# EasyEDA Pro project C108_STM32.eprj, schematic Schematic1
Board Name: Board1; Create Date: 2024-11-23; Page Name: P1; Project Name: C108_STM32; Schematic Name: Schematic1; Update Date: 2024-11-24; Company: 嘉立创EDA; Page Size: A4; Version: V1.0
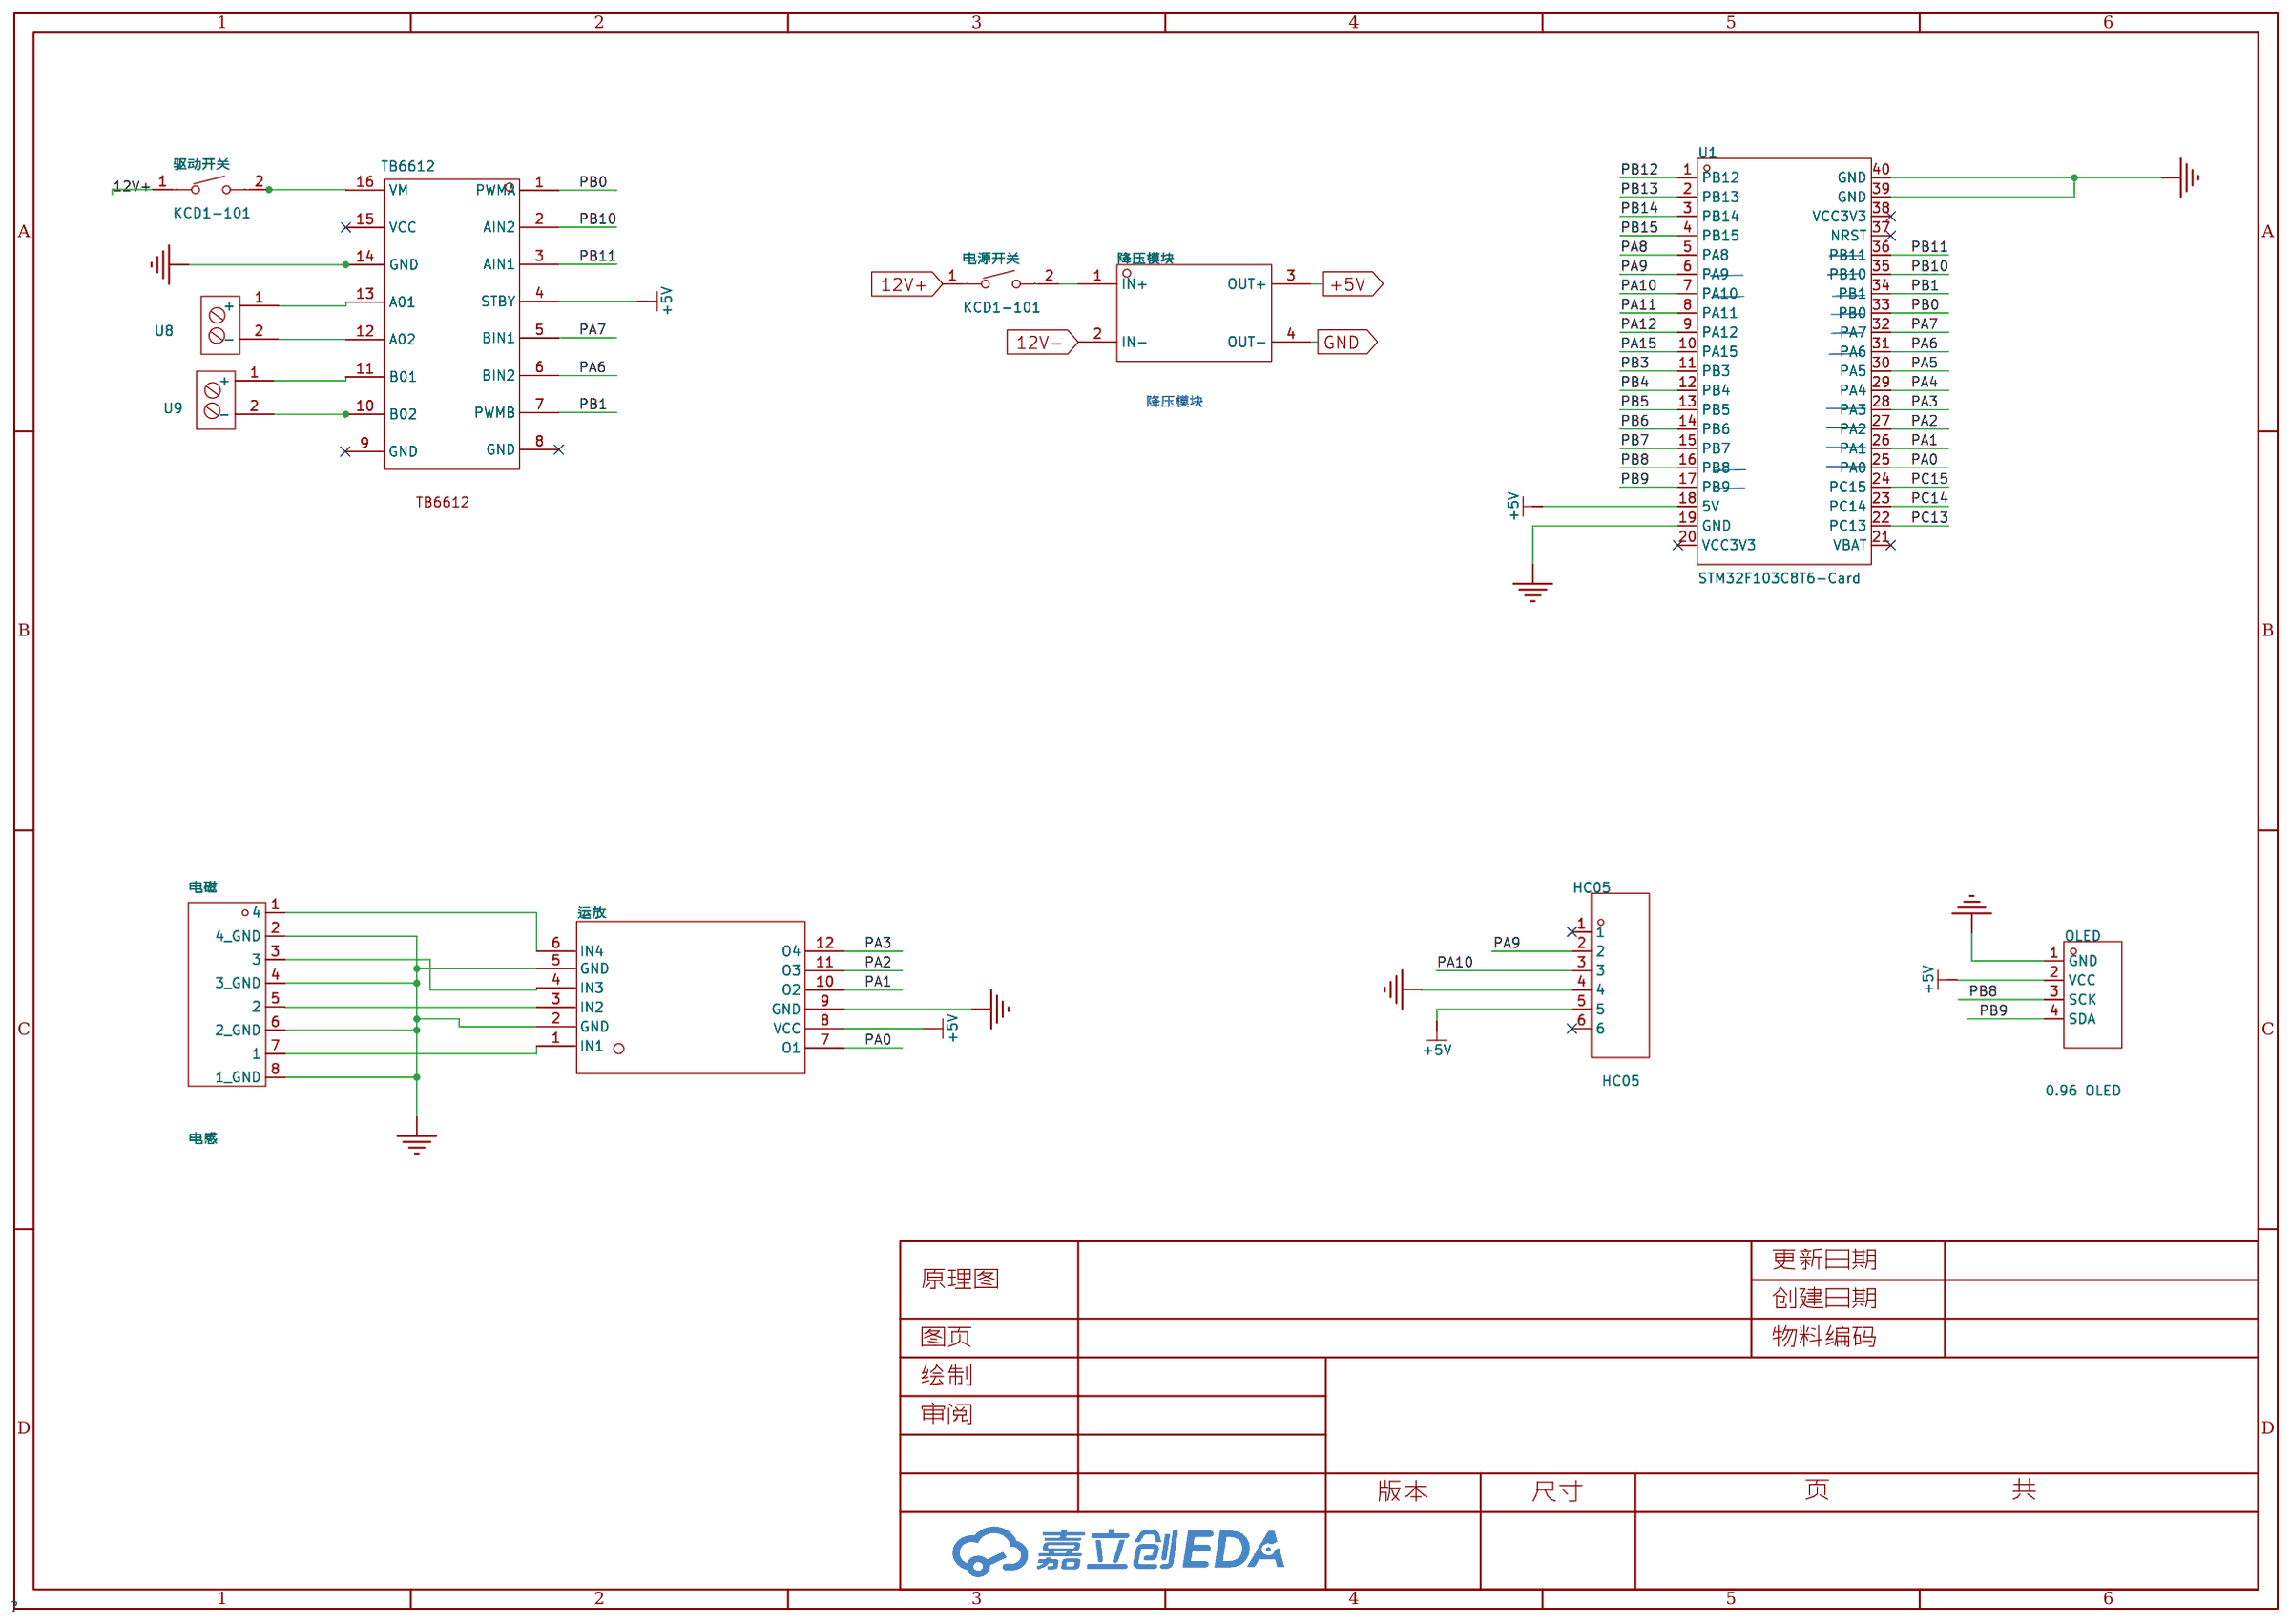
[diagram p0: schematic sheet]

## Parts
HC05  HC05  [HDR-TH_6P-P2.54-V-M]
OLED  0.96 OLED  [HDR-TH_4P-P2.54-V-M-1]
TB6612  -  [TB6612_Board]
U1  STM32F103C8T6-Card  [CONN-TH_L53.3-W22.9_STM32F103C8T6-CARD]
U8  -  [端子]
U9  -  [端子]
电源开关  KCD1-101  [SW-TH_KCD1-101]
电磁  电感  [HDR-TH_8P-P2.54-V-M]
运放  -  [逐飞运放]
降压模块  -  [稳压模块]
驱动开关  KCD1-101  [SW-TH_KCD1-101]

## Library data of the parts
HC05 = 单排2.54*6: Supplier Part: C9900016160; Supplier Footprint: 2.54x2x6; JLCPCB Part Class: 扩展库; Supplier: LCSC
OLED = 2.54*4单排: Supplier Part: C9900016163; Supplier Footprint: 2.54x4; JLCPCB Part Class: 扩展库; Supplier: LCSC
TB6612 = TB6612_Board
U1 = STM32F103C8T6-Card: Supplier Part: C9900077949; Supplier Footprint: 插件; Supplier: LCSC
U8 U9 = 端子
电源开关 驱动开关 = KCD1-101: Supplier Part: C9900022451; Supplier Footprint: Throughhole; JLCPCB Part Class: 扩展库; Supplier: LCSC
电磁 = 2.54*8单排: Supplier Part: C9900016164; Supplier Footprint: 2.54x8; JLCPCB Part Class: 扩展库; Supplier: LCSC
运放 = 逐飞运放
降压模块 = 降压模块

## Nets
12V+: 电源开关.1
12V-: 降压模块.2(IN-)
+5V: HC05.5 OLED.2(VCC) TB6612.4(STBY) U1.18(5V) 运放.8(VCC) 降压模块.3(OUT+)
GND: HC05.4 OLED.1(GND) TB6612.14(GND) U1.19(GND) U1.39(GND) U1.40(GND) 电磁.2(4_GND) 电磁.4(3_GND) 电磁.6(2_GND) 电磁.8(1_GND) 运放.2(GND) 运放.5(GND) 运放.9(GND) 降压模块.4(OUT-)
PA0: U1.25(PA0) 运放.7(O1)
PA1: U1.26(PA1) 运放.10(O2)
PA2: U1.27(PA2) 运放.11(O3)
PA3: U1.28(PA3) 运放.12(O4)
PA4: U1.29(PA4)
PA5: U1.30(PA5)
PA6: TB6612.6(BIN2) U1.31(PA6)
PA7: TB6612.5(BIN1) U1.32(PA7)
PA8: U1.5(PA8)
PA9: HC05.2 U1.6(PA9)
PA10: HC05.3 U1.7(PA10)
PA11: U1.8(PA11)
PA12: U1.9(PA12)
PA15: U1.10(PA15)
PB0: TB6612.1(PWMA) U1.33(PB0)
PB1: TB6612.7(PWMB) U1.34(PB1)
PB3: U1.11(PB3)
PB4: U1.12(PB4)
PB5: U1.13(PB5)
PB6: U1.14(PB6)
PB7: U1.15(PB7)
PB8: OLED.3(SCK) U1.16(PB8)
PB9: OLED.4(SDA) U1.17(PB9)
PB10: TB6612.2(AIN2) U1.35(PB10)
PB11: TB6612.3(AIN1) U1.36(PB11)
PB12: U1.1(PB12)
PB13: U1.2(PB13)
PB14: U1.3(PB14)
PB15: U1.4(PB15)
PC13: U1.22(PC13)
PC14: U1.23(PC14)
PC15: U1.24(PC15)
$1N3334: TB6612.16(VM) 驱动开关.2
$1N4039: TB6612.13(A01) U8.1(+)
$1N4051: TB6612.11(B01) U9.1(+)
$1N4057: TB6612.10(B02) U9.2(-)
$1N4971: 电磁.7(1) 运放.1(IN1)
$1N5000: 电磁.5(2) 运放.3(IN2)
$1N5005: 电磁.3 运放.4(IN3)
$1N5016: 电磁.1(4) 运放.6(IN4)
Net-(电源开关-2): 电源开关.2 降压模块.1(IN+)

Not connected (* = marked no-connect by the designer): HC05 1* 6*; TB6612 8(GND)* 9(GND)* 12(A02) 15(VCC)*; U1 20(VCC3V3)* 21(VBAT)* 37(NRST)* 38(VCC3V3)*; U8 2(-); 驱动开关 1

## Notes on the sheet
- 降压模块
